# Altium schematic sheet Core.SchDoc (continued)
## Parts (continued)
C39  value 100nF  Note: ±10%  Type: 0201  [CAP_0201]  (hidden comment: C0201)
C40  value 100nF  Note: ±10%  Type: 0201  [CAP_0201]  (hidden comment: C0201)
C41  value 4.7uF  Note: ±10%  Type: 0402  [CAP_0402]  (hidden comment: C0402)
C42  value 4.7uF  Note: ±10%  Type: 0402  [CAP_0402]  (hidden comment: C0402)
C43  value 100nF  Note: ±10%  Type: 0201  [CAP_0201]  (hidden comment: C0201)
C44  value 1nF  Note: ±10%  Type: 0402  [CAP_0402]  (hidden comment: C0402)
C45  value 1nF  Note: ±10%  Type: 0402  [CAP_0402]  (hidden comment: C0402)
C46  value 100nF  Note: ±10%  Type: 0201  [CAP_0201]  (hidden comment: C0201)
C47  value 100nF  Note: ±10%  Type: 0201  [CAP_0201]  (hidden comment: C0201)
C48  value 100nF  Note: ±10%  Type: 0201  [CAP_0201]  (hidden comment: C0201)
C49  value 10uF  Note: ±10%  Type: 0603  [CAP_0603]  (hidden comment: C0603)
C50  value 10uF  Note: ±10%  Type: 0603  [CAP_0603]  (hidden comment: C0603)
C51  value 100nF  Note: ±10%  Type: 0402  [CAP_0402]  (hidden comment: C0402)
C52  value 100nF  Note: ±10%  Type: 0402  [CAP_0402]  (hidden comment: C0402)
C53  value 100nF  Note: ±10%  Type: 0402  [CAP_0402]  (hidden comment: C0402)
C54  value 100nF  Note: ±10%  Type: 0402  [CAP_0402]  (hidden comment: C0402)
C55  value 100nF  Note: ±10%  Type: 0402  [CAP_0402]  (hidden comment: C0402)
C56  value 100nF  Note: ±10%  Type: 0402  [CAP_0402]  (hidden comment: C0402)
C57  value 100nF  Note: ±10%  Type: 0201  [CAP_0201]  (hidden comment: C0201)
C58  value 22uF  Note: ±10%  Type: 0603  [CAP_0603]  (hidden comment: C0603)
C59  value 10uF  Note: ±10%  Type: 0603  [CAP_0603]  (hidden comment: C0603)
C60  value 10uF  Note: ±10%  Type: 0603  [CAP_0603]  (hidden comment: C0603)
C61  value 1uF  Note: ±10%  Type: 0402  [CAP_0402]  (hidden comment: C0402)
C62  value 100nF  Note: ±10%  Type: 0402  [CAP_0402]  (hidden comment: C0402)
C63  value 100nF  Note: ±10%  Type: 0402  [CAP_0402]  (hidden comment: C0402)
C64  value 100nF  Note: ±10%  Type: 0402  [CAP_0402]  (hidden comment: C0402)
C65  value 100nF  Note: ±10%  Type: 0402  [CAP_0402]  (hidden comment: C0402)
C66  value 100nF  Note: ±10%  Type: 0402  [CAP_0402]  (hidden comment: C0402)
C67  value 100nF  Note: ±10%  Type: 0402  [CAP_0402]  (hidden comment: C0402)
C68  value 100nF  Note: ±10%  Type: 0402  [CAP_0402]  (hidden comment: C0402)
C69  value 100nF  Note: ±10%  Type: 0402  [CAP_0402]  (hidden comment: C0402)
C70  value 100nF  Note: ±10%  Type: 0402  [CAP_0402]  (hidden comment: C0402)
C71  value 100nF  Note: ±10%  Type: 0402  [CAP_0402]  (hidden comment: C0402)
C72  value 100nF  Note: ±10%  Type: 0402  [CAP_0402]  (hidden comment: C0402)
C73  value 100nF  Note: ±10%  Type: 0402  [CAP_0402]  (hidden comment: C0402)
C74  value 100nF  Note: ±10%  Type: 0402  [CAP_0402]  (hidden comment: C0402)
C75  value 100nF  Note: ±10%  Type: 0402  [CAP_0402]  (hidden comment: C0402)
C76  value 100nF  Note: ±10%  Type: 0402  [CAP_0402]  (hidden comment: C0402)
C77  value 100nF  Note: ±10%  Type: 0402  [CAP_0402]  (hidden comment: C0402)
C78  value 22uF  Note: ±10%  Type: 0603  [CAP_0603]  (hidden comment: C0603)
C79  value 10uF  Note: ±10%  Type: 0603  [CAP_0603]  (hidden comment: C0603)
C80  value 10uF  Note: ±10%  Type: 0603  [CAP_0603]  (hidden comment: C0603)
C81  value 1uF  Note: ±10%  Type: 0402  [CAP_0402]  (hidden comment: C0402)
C82  value 100nF  Note: ±10%  Type: 0402  [CAP_0402]  (hidden comment: C0402)
C83  value 100nF  Note: ±10%  Type: 0402  [CAP_0402]  (hidden comment: C0402)
C84  value 100nF  Note: ±10%  Type: 0402  [CAP_0402]  (hidden comment: C0402)
C85  value 100nF  Note: ±10%  Type: 0402  [CAP_0402]  (hidden comment: C0402)
C86  value 100nF  Note: ±10%  Type: 0402  [CAP_0402]  (hidden comment: C0402)
C87  value 100nF  Note: ±10%  Type: 0402  [CAP_0402]  (hidden comment: C0402)
C88  value 100nF  Note: ±10%  Type: 0402  [CAP_0402]  (hidden comment: C0402)
C89  value 100nF  Note: ±10%  Type: 0402  [CAP_0402]  (hidden comment: C0402)
C90  value 100nF  Note: ±10%  Type: 0402  [CAP_0402]  (hidden comment: C0402)
C91  value 100nF  Note: ±10%  Type: 0402  [CAP_0402]  (hidden comment: C0402)
C92  value 100nF  Note: ±10%  Type: 0402  [CAP_0402]  (hidden comment: C0402)
C93  value 100nF  Note: ±10%  Type: 0402  [CAP_0402]  (hidden comment: C0402)
C94  value 100nF  Note: ±10%  Type: 0402  [CAP_0402]  (hidden comment: C0402)
C95  value 100nF  Note: ±10%  Type: 0402  [CAP_0402]  (hidden comment: C0402)
C96  value 100nF  Note: ±10%  Type: 0402  [CAP_0402]  (hidden comment: C0402)
C97  value 100nF  Note: ±10%  Type: 0402  [CAP_0402]  (hidden comment: C0402)
C98  value 100nF  Note: ±10%  Type: 0402  [CAP_0402]  (hidden comment: C0402)
C99  value 100nF  Note: ±10%  Type: 0402  [CAP_0402]  (hidden comment: C0402)
C100  value 4.7uF  Note: ±10%  Type: 0402  [CAP_0402]  (hidden comment: C0402)
C101  value 22uF  Note: ±10%  Type: 0603  [CAP_0603]  (hidden comment: C0603)
C102  value 22uF  Note: ±10%  Type: 0603  [CAP_0603]  (hidden comment: C0603)
C103  value 22uF  Note: ±10%  Type: 0603  [CAP_0603]  (hidden comment: C0603)
C104  value 100nF  Note: ±10%  Type: 0201  [CAP_0201]  (hidden comment: C0201)
C105  value 100nF  Note: ±10%  Type: 0201  [CAP_0201]  (hidden comment: C0201)
C106  value 100nF  Note: ±10%  Type: 0201  [CAP_0201]  (hidden comment: C0201)
C107  value 4.7uF  Note: ±10%  Type: 0402  [CAP_0402]  (hidden comment: C0402)
C108  value 4.7uF  Note: ±10%  Type: 0402  [CAP_0402]  (hidden comment: C0402)
C109  value 4.7uF  Note: ±10%  Type: 0402  [CAP_0402]  (hidden comment: C0402)
C110  value 10uF  Note: ±10%  Type: 0603  [CAP_0603]  (hidden comment: C0603)
C111  value 22uF  Note: ±10%  Type: 0603  [CAP_0603]  (hidden comment: C0603)
C112  value 22uF  Note: ±10%  Type: 0603  [CAP_0603]  (hidden comment: C0603)
C113  value 100nF  Note: ±10%  Type: 0201  [CAP_0201]  (hidden comment: C0201)
C114  value 4.7uF  Note: ±10%  Type: 0402  [CAP_0402]  (hidden comment: C0402)
C115  value 10uF  Note: ±10%  Type: 0603  [CAP_0603]  (hidden comment: C0603)
C116  value 22uF  Note: ±10%  Type: 0603  [CAP_0603]  (hidden comment: C0603)
C117  value 22uF  Note: ±10%  Type: 0603  [CAP_0603]  (hidden comment: C0603)
C118  value 100nF  Note: ±10%  Type: 0201  [CAP_0201]  (hidden comment: C0201)
C119  value 10uF  Note: ±10%  Type: 0603  [CAP_0603]  (hidden comment: C0603)
C120  value 22uF  Note: ±10%  Type: 0603  [CAP_0603]  (hidden comment: C0603)
C121  value 22uF  Note: ±10%  Type: 0603  [CAP_0603]  (hidden comment: C0603)
C122  value 100nF  Note: ±10%  Type: 0201  [CAP_0201]  (hidden comment: C0201)
R1  value 22Ω  Note: ±1%  Type: 0402  [RES_0402]  (hidden comment: R0402)
R2  value 1MΩ  Note: ±1%  Type: 0402  [RES_0402]  (hidden comment: R0402)
R3  value 10K  Note: ±1%  Type: 0402  [RES_0402]  (hidden comment: R0402)
R4  value 2.2K  Note: ±1%  Type: 0402  [RES_0402]  (hidden comment: R0402)
R5  value 2.2K  Note: ±1%  Type: 0402  [RES_0402]  (hidden comment: R0402)
R6  value 22Ω  Note: ±1%  Type: 0402  [RES_0402]  (hidden comment: R0402)
R7  value 1.62K  Note: ±1%  Type: 0402  [RES_0402]  (hidden comment: R0402)
R8  value 120Ω  Note: ±1%  Type: 0402  [RES_0402]  (hidden comment: R0402)
R9  value 22Ω  Note: ±1%  Type: 0402  [RES_0402]  (hidden comment: R0402)
R10  value 10K  Note: ±1%  Type: 0402  [RES_0402]  (hidden comment: R0402)
R11  value 240Ω  Note: ±1%  Type: 0402  [RES_0402]  (hidden comment: R0402)
R12  value 240Ω  Note: ±1%  Type: 0402  [RES_0402]  (hidden comment: R0402)
R13  value 22Ω  Note: ±1%  Type: 0402  [RES_0402]  (hidden comment: R0402)
R15  value 15K  Note: ±1%  Type: 0402  [RES_0402]  (hidden comment: R0402)
U1  RK3566  [RK3566]  (value not drawn)  (parts A,B,C,D,E,F,G,H,I,J,K,L,M,N,O,P,Q,R,S,T,U,V of 22)
U2  LPDDR4  [LPDDR4]  (value not drawn)  (parts A,B of 2)
X1  24MHz  [OSC-SMD_4P-L3.2-W2.5-BL]

## Nets
GND: C1.1 C2.1 C3.1 C4.1 C5.1 C6.1 C7.1 C8.1 C9.2 C10.1 C11.1 C12.1 C13.1 C14.1 C15.1 C16.1 C17.1 C18.2 C19.1 C20.1 C21.1 C22.1 C23.1 C24.2 C25.1 C26.1 C27.1 C28.1 C29.1 C30.1 C31.1 C32.1 C33.1 C34.1 C35.1 C36.1 C37.1 C38.1 C39.1 C40.1 C41.1 C42.1 C43.1 C44.1 C45.1 C46.2 C47.2 C48.2 C49.1 C50.1 C51.1 C52.1 C53.1 C54.1 C55.1 C56.1 C57.2 C58.1 C59.1 C60.1 C61.1 C62.1 C63.1 C64.1 C65.1 C66.1 C67.1 C68.1 C69.1 C70.1 C71.1 C72.1 C73.1 C74.1 C75.1 C76.1 C77.1 C78.1 C79.1 C80.1 C81.1 C82.1 C83.1 C84.1 C85.1 C86.1 C87.1 C88.1 C89.1 C90.1 C91.1 C92.1 C93.1 C94.1 C95.1 C96.1 C97.1 C98.1 C99.1 C100.1 C101.1 C102.1 C103.1 C104.1 C105.1 C106.1 C107.1 C108.1 C109.1 C110.1 C111.1 C112.1 C113.1 C114.1 C115.1 C116.1 C117.1 C118.1 C119.1 C120.1 C121.1 C122.2 R7.2 R15.1 U1.1B10(VSS_30) U1.1B11(VSS_31) U1.1B15(VSS_32) U1.1B19(VSS_33) U1.1C4(VSS_34) U1.1C5(VSS_35) U1.1C6(VSS_36) U1.1C8(VSS_37) U1.1C9(VSS_38) U1.1C14(VSS_39) U1.1C16(VSS_40) U1.1C18(VSS_41) U1.1D1(VSS_42) U1.1D3(VSS_43) U1.1D4(DDR_AVSS) U1.1D10(VSS_44) U1.1D14(VSS_45) U1.1E3(VSS_46) U1.1E8(VSS_47) U1.1E10(VSS_48) U1.1E14(VSS_49) U1.1E15(VSS_50) U1.1E17(VSS_51) U1.1F6(VSS_52) U1.1F7(VSS_53) U1.1F8(VSS_54) U1.1F9(VSS_55) U1.1F10(VSS_56) U1.1F15(VSS_57) U1.1F16(VSS_58) U1.1F20(AVSS1_6) U1.1G3(VSS_59) U1.1G6(VSS_60) U1.1G7(VSS_61) U1.1G8(VSS_62) U1.1G9(VSS_63) U1.1G10(VSS_64) U1.1G11(VSS_65) U1.1G12(VSS_66) U1.1G14(VSS_67) U1.1G16(AVSS1_7) U1.1G17(EDP_TX_AVDD_1V8) U1.1G18(AVSS1_8) U1.1G19(AVSS1_9) U1.1G20(AVSS1_10) U1.1H1(VSS_68) U1.1H2(VSS_69) U1.1H6(VSS_70) U1.1H11(VSS_71) U1.1H12(VSS_72) U1.1H13(VSS_73) U1.1H17(EDP_TX_AVDD_0V9) U1.1J1(VSS_74) U1.1J5(SYSPLL_AVSS) U1.1J6(VSS_75) U1.1J8(VSS_76) U1.1J9(VSS_77) U1.1J11(VSS_78) U1.1J12(VSS_79) U1.1J13(VSS_80) U1.1J16(AVSS1_11) U1.1J18(AVSS1_12) U1.1K2(VSS_81) U1.1K3(VSS_82) U1.1K4(VSS_83) U1.1K5(VSS_84) U1.1K6(VSS_85) U1.1K8(VSS_86) U1.1K9(VSS_87) U1.1K11(VSS_88) U1.1K12(VSS_89) U1.1K13(VSS_90) U1.1K14(VSS_91) U1.1K15(VSS_92) U1.1K18(AVSS1_13) U1.1L3(VSS_93) U1.1L6(VSS_94) U1.1L10(VSS_95) U1.1L11(VSS_96) U1.1L12(VSS_97) U1.1L13(VSS_98) U1.1L14(VSS_99) U1.1L15(VSS_100) U1.1L19(AVSS1_14) U1.1M3(VSS_101) U1.1M4(VSS_102) U1.1M5(VSS_103) U1.1M6(VSS_104) U1.1M10(VSS_105) U1.1M11(VSS_106) U1.1M12(VSS_107) U1.1M13(VSS_108) U1.1M14(VSS_109) U1.1M15(VSS_110) U1.1M16(VSS_111) U1.1M17(VSS_112) U1.1M18(TVSS) U1.1M20(VSS_113) U1.1N3(VSS_114) U1.1N4(VSS_115) U1.1N7(VSS_116) U1.1N9(MIPI_CSI_RX_AVDD_0V9) U1.1N10(MIPI_DSI_TX1_AVDD_0V9) U1.1N11(AVSS_9) U1.1N12(AVSS_10) U1.1N17(PMUPLL_AVSS) U1.1P1(VSS_117) U1.1P5(VSS_118) U1.1P6(VSS_119) U1.1P7(VSS_120) U1.1P8(AVSS_11) U1.1P9(MIPI_CSI_RX_AVDD_1V8) U1.1P10(AVSS_12) U1.1P11(MIPI_DSI_TX0/LVDS_TX0_AVDD_0V9) U1.1P12(MIPI_DSI_TX0/LVDS_TX0_AVDD_1V8) U1.1P14(AVSS_13) U1.1P15(VSS_121) U1.1R3(VSS_122) U1.1R4(VSS_123) U1.1R5(VSS_124) U1.1R6(VSS_125) U1.1R7(VSS_126) U1.1R8(AVSS_14) U1.1R9(AVSS_15) U1.1R10(MIPI_DSI_TX1_AVDD_1V8) U1.1R11(AVSS_16) U1.1R12(AVSS_17) U1.1R13(AVSS_18) U1.1R14(AVSS_19) U1.1R15(AVSS_20) U1.1T3(VSS_127) U1.1T5(VSS_128) U1.1T7(AVSS_21) U1.1T8(AVSS_22) U1.1T9(AVSS_23) U1.1T10(AVSS_24) U1.1T11(AVSS_25) U1.1T12(AVSS_26) U1.1T13(AVSS_27) U1.1T14(AVSS_28) U1.1T15(AVSS_29) U1.1T16(AVSS_30) U1.1T17(AVSS_31) U1.1U2(VSS_129) U1.1U12(AVSS_32) U1.1U13(AVSS_33) U1.1U15(AVSS_34) U1.1U17(AVSS_35) U1.1V1(VSS_130) U1.1V4(VSS_131) U1.1V7(AVSS_36) U1.1V12(AVSS_37) U1.1V13(AVSS_38) U1.1V18(AVSS_39) U1.A1(VSS_1) U1.A2(VSS_2) U1.A38(VSS_3) U1.AA2(VSS_18) U1.AC37(VSS_24) U1.AD2(VSS_19) U1.AE37(VSS_25) U1.AH37(VSS_26) U1.AL37(VSS_27) U1.AP2(VSS_20) U1.AP8(VSS_22) U1.AP13(AVSS_1) U1.AP16(AVSS_2) U1.AP19(AVSS_3) U1.AP22(AVSS_4) U1.AP25(AVSS_5) U1.AP28(AVSS_6) U1.AP31(AVSS_7) U1.AP34(AVSS_8) U1.AP37(VSS_28) U1.AR1(VSS_21) U1.AR38(VSS_29) U1.B1(VSS_4) U1.B2(VSS_5) U1.B6(VSS_6) U1.B11(VSS_7) U1.B14(VSS_8) U1.B18(VSS_9) U1.B21(VSS_10) U1.B28(VSS_11) U1.B31(VSS_12) U1.D2(VSS_13) U1.E37(VSS_23) U1.H37(AVSS1_1) U1.J2(VSS_14) U1.L2(VSS_15) U1.L37(AVSS1_2) U1.P37(AVSS1_3) U1.U2(VSS_16) U1.U37(AVSS1_4) U1.W2(VSS_17) U1.Y37(AVSS1_5) U2.A3(VSS_1) U2.A10(VSS_2) U2.AB3(VSS_55) U2.AB5(VSS_56) U2.AB8(VSS_57) U2.AB10(VSS_58) U2.C1(VSS_3) U2.C5(VSS_4) U2.C8(VSS_5) U2.C12(VSS_6) U2.D2(VSS_7) U2.D4(VSS_8) U2.D9(VSS_9) U2.D11(VSS_10) U2.E1(VSS_11) U2.E5(VSS_12) U2.E8(VSS_13) U2.E12(VSS_14) U2.G1(VSS_15) U2.G3(VSS_16) U2.G5(VSS_17) U2.G8(VSS_18) U2.G10(VSS_19) U2.G12(VSS_20) U2.J1(VSS_21) U2.J3(VSS_22) U2.J10(VSS_23) U2.J12(VSS_24) U2.K2(VSS_25) U2.K4(VSS_26) U2.K9(VSS_27) U2.K11(VSS_28) U2.N2(VSS_29) U2.N4(VSS_30) U2.N9(VSS_31) U2.N11(VSS_32) U2.P1(VSS_33) U2.P3(VSS_34) U2.P10(VSS_35) U2.P12(VSS_36) U2.T1(VSS_37) U2.T3(VSS_38) U2.T5(VSS_39) U2.T8(VSS_40) U2.T10(VSS_41) U2.T12(VSS_42) U2.V1(VSS_43) U2.V5(VSS_44) U2.V8(VSS_45) U2.V12(VSS_46) U2.W2(VSS_47) U2.W4(VSS_48) U2.W9(VSS_49) U2.W11(VSS_50) U2.Y1(VSS_51) U2.Y5(VSS_52) U2.Y8(VSS_53) U2.Y12(VSS_54) X1.2(GND) X1.4(GND)
VCC0V6_DDR: C33.2 C34.2 C35.2 C36.2 C38.2 C39.2 C40.2 C41.2 C42.2 C58.2 C59.2 C60.2 C61.2 C62.2 C63.2 C64.2 C65.2 C66.2 C67.2 C68.2 C69.2 C70.2 C71.2 C72.2 C73.2 C74.2 C75.2 C76.2 C77.2 C78.2 C79.2 C80.2 C81.2 C82.2 C83.2 C84.2 C85.2 C86.2 C87.2 C88.2 C89.2 C90.2 C91.2 C92.2 C93.2 C94.2 C95.2 C96.2 C97.2 C98.2 C99.2 R8.2 R11.1 R12.2 U1.1D5(DDR_VDDQ_1) U1.1D6(DDR_VDDQ_2) U1.1D7(DDR_VDDQ_3) U1.1D8(DDR_VDDQ_4) U1.1D9(DDR_VDDQ_5) U1.1E4(DDR_VDDQ_6) U1.1E6(DDR_VDDQL_1) U1.1E7(DDR_VDDQL_2) U1.1E9(DDR_VDDQL_3) U1.1F4(DDR_VDDQ_7) U1.1F5(DDR_VDDQL_4) U1.1G4(DDR_VDDQ_8) U1.1G5(DDR_VDDQL_5) U2.A4(VDD2_1) U2.A9(VDD2_2) U2.AA3(VDDQ_17) U2.AA5(VDDQ_18) U2.AA8(VDDQ_19) U2.AA10(VDDQ_20) U2.AB4(VDD2_23) U2.AB9(VDD2_24) U2.B3(VDDQ_1) U2.B5(VDDQ_2) U2.B8(VDDQ_3) U2.B10(VDDQ_4) U2.D1(VDDQ_5) U2.D5(VDDQ_6) U2.D8(VDDQ_7) U2.D12(VDDQ_8) U2.F3(VDDQ_9) U2.F5(VDD2_3) U2.F8(VDD2_4) U2.F10(VDDQ_10) U2.H1(VDD2_5) U2.H5(VDD2_6) U2.H8(VDD2_7) U2.H12(VDD2_8) U2.K1(VDD2_9) U2.K3(VDD2_10) U2.K10(VDD2_11) U2.K12(VDD2_12) U2.N1(VDD2_13) U2.N3(VDD2_14) U2.N10(VDD2_15) U2.N12(VDD2_16) U2.R1(VDD2_17) U2.R5(VDD2_18) U2.R8(VDD2_19) U2.R12(VDD2_20) U2.U3(VDDQ_11) U2.U5(VDD2_21) U2.U8(VDD2_22) U2.U10(VDDQ_12) U2.W1(VDDQ_13) U2.W5(VDDQ_14) U2.W8(VDDQ_15) U2.W12(VDDQ_16)  [also labelled VCC_DDR]
VCC1V8_DDR: C14.2 C15.2 C49.2 C50.2 C51.2 C52.2 C53.2 C54.2 C55.2 C56.2 U1.1N18(PMUPLL_AVDD_1V9) U2.F1(VDD1) U2.F12(VDD1_2) U2.G4(VDD1_3) U2.G9(VDD1_4) U2.T4(VDD1_5) U2.T9(VDD1_6) U2.U1(VDD1_7) U2.U12(VDD1_8)  [also labelled VCCA1V8_PMU]
VCC3V3_PMU: C9.1 C18.1 R3.2 R4.1 R5.1 U1.1N15(PMUIO2) U1.1P16(PMUIO1)
VCC_1V8: C27.2 C30.2 C57.1 U1.1C13(VCCIO2) U1.1E16(VCCIO4)  [also labelled VCCIO_FLASH, VCCIO_WL]
VCC_3V3: C6.2 C13.2 C47.1 C48.1 U1.1H18(USB_AVDD1_3V3) U1.1J2(USB_AVDD2_3V3) U1.1N5(VCCIO5_1) U1.1N6(VCCIO5_2) U1.1N8(VCCIO7)
VCCA1V8_IMAGE: C31.2 C32.2 U1.1P13(HDMI_TX_AVDD_1V8)
VCCA_1V8: C7.2 C10.2 C19.2 C22.2 C23.2 C46.1 R10.2 U1.1D15(OTP_VCC18) U1.1D16(SARADC_AVDD_1V8) U1.1H4(SYSPLL_AVDD_1V8) U1.1H16(USB_AVDD1_1V9) U1.1J3(USB_AVDD2_1V8) U1.1K17(MULTI_PHY_AVDD_1V8)
VCCIO_ACODEC: C122.1 U1.1D13(VCCIO1)
VCCIO_SD: C43.2 U1.1F17(VCCIO3)
VDD_CPU: C37.2 C100.2 C101.2 C102.2 C103.2 C104.2 C105.2 U1.1C12(VDD_CPU_1) U1.1D11(VDD_CPU_2) U1.1D12(VDD_CPU_3) U1.1E11(VDD_CPU_4) U1.1E12(VDD_CPU_5) U1.1E13(VDD_CPU_6) U1.1F11(VDD_CPU_7) U1.1F12(VDD_CPU_8) U1.1F13(VDD_CPU_9) U1.1F14(VDD_CPU_10) U1.1G13(VDD_CPU_11)
VDD_GPU: C113.2 C114.2 C115.2 C116.2 C117.2 U1.1L8(VDD_GPU_1) U1.1L9(VDD_GPU_2) U1.1M7(VDD_GPU_3) U1.1M8(VDD_GPU_4) U1.1M9(VDD_GPU_5)
VDD_LOGIC: C106.2 C107.2 C108.2 C109.2 C110.2 C111.2 C112.2 U1.1H7(VDD_LOGIC_1) U1.1H8(VDD_LOGIC_2) U1.1H9(VDD_LOGIC_3) U1.1H10(VDD_LOGIC_4) U1.1J7(VDD_LOGIC_5) U1.1J10(VDD_LOGIC_6) U1.1K7(VDD_LOGIC_7) U1.1K10(VDD_LOGIC_8) U1.1L7(VDD_LOGIC_9)
VDD_NPU: C118.2 C119.2 C120.2 C121.2 U1.1G15(VDD_NPU_1) U1.1H14(VDD_NPU_2) U1.1H15(VDD_NPU_3) U1.1J14(VDD_NPU_4) U1.1J15(VDD_NPU_5)
VDDA0V9_IMAGE: C28.2 C29.2 U1.1N13(HDMI_TX_AVDD_02V9_2) U1.1N14(HDMI_TX_AVDD_02V9_1)
VDDA0V9_PMU: C11.2 C12.2 C24.1 C25.2 U1.1N16(PMU_VDD_LOGIC_0V9) U1.1P17(PMUPLL_AVDD_0V9)
VDDA_0V9: C5.2 C8.2 C16.2 C17.2 C20.2 C21.2 U1.1H5(SYSPLL_AVDD_0V9) U1.1J4(USB_AVDD2_0V9) U1.1J17(USB_AVDD1_0V9) U1.1K16(MULTI_PHY_AVDD_0V9)
BT_REG_ON_H: U1.D38(GPIO2_B7_d)
BT_WAKE_HOST_H: U1.A37(GPIO2_C0_d)
EMMC_CLKOUT: R6.2
EMMC_CMD: U1.A27(GPIO1_C4_u)
EMMC_D0: U1.A32(GPIO1_B4_u)
EMMC_D1: U1.B27(GPIO1_B5_u)
EMMC_D2: U1.B32(GPIO1_B6_u)
EMMC_D3: U1.B29(GPIO1_B7_u)
EMMC_D4: U1.B33(GPIO1_C0_u)
EMMC_D5: U1.A30(GPIO1_C1_u)
EMMC_D6: U1.B30(GPIO1_C2_u)
EMMC_D7: U1.A33(GPIO1_C3_u)
EMMC_DATA_STROBE: U1.1A16(GPIO1_C6_d)
EMMC_RSTN: U1.1B16(GPIO1_C7_d)
FLASH_VOL_SEL: R3.1 U1.AF38(GPIO0_A7_u)
HDMI_TX_CLK_N: U1.AP32(HDMI_TX_CLKn)
HDMI_TX_CLK_P: U1.AR32(HDMI_TX_CLKp)
HDMI_TX_D0_N: U1.AR33(HDMI_TX_D0n)
HDMI_TX_D0_P: U1.AP33(HDMI_TX_D0p)
HDMI_TX_D1_N: U1.AP35(HDMI_TX_D1n)
HDMI_TX_D1_P: U1.AR35(HDMI_TX_D1p)
HDMI_TX_D2_N: U1.AR36(HDMI_TX_D2n)
HDMI_TX_D2_P: U1.AP36(HDMI_TX_D2p)
HDMI_TX_HPDIN: C26.2 U1.1V17(HDMI_TX_HPDIN)
HDMITX_CEC_M0: U1.1V5(GPIO4_D1_u)
HDMITX_SCL: U1.AR12(GPIO4_C7_u)
HDMITX_SDA: U1.AP11(GPIO4_D0_u)
HOST_WAKE_BT_H: U1.B36(GPIO2_C1_d)
HW_ID: C45.2 R10.1 U1.1C17(SARADC_VIN1)
I2C0_SCL_PMIC: R4.2 U1.AJ37(GPIO0_B1_u)
I2C0_SDA_PMIC: R5.2 U1.AK38(GPIO0_B2_u)
I2S1_LRCK_TX_M0_PMIC: U1.B24(GPIO1_A5_d)
I2S1_MCLK_M0_PMIC: U1.A23(GPIO1_A2_d)
I2S1_SCLK_TX_M0_PMIC: U1.B23(GPIO1_A3_d)
I2S1_SDI0_M0/PDM: U1.1B14(GPIO1_B3_d)
I2S1_SDO0_M0_PMIC: U1.B25(GPIO1_A7_d)
I2S2_LRCK_TX_M0: U1.1D19(GPIO2_C3_d)
I2S2_SCLK_TX_M0: U1.C37(GPIO2_C2_d)
I2S2_SDI_M0: U1.D37(GPIO2_C5_d)
I2S2_SDO_M0: U1.1B20(GPIO2_C4_d)
LPDDR4_A0_A: U1.C2(LPDDR4_A0_A) U2.H2(CA0_A)
LPDDR4_A0_B: U1.A9(LPDDR4_A0_B) U2.R2(CA0_B)
LPDDR4_A1_A: U1.C1(LPDDR4_A1_A) U2.J2(CA1_A)
LPDDR4_A1_B: U1.B9(LPDDR4_A1_B) U2.P2(CA1_B)
LPDDR4_A2_A: U1.1C1(LPDDR4_A2_A) U2.H9(CA2_A)
LPDDR4_A2_B: U1.1B7(LPDDR4_A2_B) U2.R9(CA2_B)
LPDDR4_A3_A: U1.1B3(LPDDR4_A3_A) U2.H10(CA3_A)
LPDDR4_A3_B: U1.1B6(LPDDR4_A3_B) U2.R10(CA3_B)
LPDDR4_A4_A: U1.1B1(LPDDR4_A4_A) U2.H11(CA4_A)
LPDDR4_A4_B: U1.1A6(LPDDR4_A4_B) U2.R11(CA4_B)
LPDDR4_A5_A: U1.1A1(LPDDR4_A5_A) U2.J11(CA5_A)
LPDDR4_A5_B: U1.B8(LPDDR4_A5_B) U2.P11(CA5_B)
LPDDR4_CKE0_A: U1.B4(LPDDR4_CKE0_A) U2.J4(CKE0_A)
LPDDR4_CKE0_B: U1.1A3(LPDDR4_CKE0_B) U2.P4(CKE0_B)
LPDDR4_CKE1_A: U1.1C3(LPDDR4_CKE1_A) U2.J5(CKE1_A)
LPDDR4_CKE1_B: U1.1A2(LPDDR4_CKE1_B) U2.P5(CKE1_B)
LPDDR4_CLK_A_N: U1.B5(LPDDR4_CLKN_A) U2.J9(CK_c_A)
LPDDR4_CLK_A_P: U1.A5(LPDDR4_CLKP_A) U2.J8(CK_t_A)
LPDDR4_CLK_B_N: U1.B7(LPDDR4_CLKN_B) U2.P9(CK_c_B)
LPDDR4_CLK_B_P: U1.A7(LPDDR4_CLKP_B) U2.P8(CK_t_B)
LPDDR4_CS0N_A: U1.B3(LPDDR4_CS0n_A) U2.H4(CS0_A)
LPDDR4_CS0N_B: U1.1B5(LPDDR4_CS0n_B) U2.R4(CS0_B)
LPDDR4_CS1N_A: U1.A3(LPDDR4_CS1n_A) U2.H3(CS1_A)
LPDDR4_CS1N_B: U1.1A5(LPDDR4_CS1n_B) U2.R3(CS1_B)
LPDDR4_DM0_A: U1.1E2(LPDDR4_DM0_A) U2.C3(DMI0_A)
LPDDR4_DM0_B: U1.1B8(LPDDR4_DM0_B) U2.Y3(DMI0_B)
LPDDR4_DM1_A: U1.1G1(LPDDR4_DM1_A) U2.C10(DMI1_A)
LPDDR4_DM1_B: U1.1A11(LPDDR4_DM1_B) U2.Y10(DMI1_B)
LPDDR4_DQ0_A: U1.G2(LPDDR4_DQ0_A) U2.B2(DQ0_A)
LPDDR4_DQ0_B: U1.B12(LPDDR4_DQ0_B) U2.AA2(DQ0_B)
LPDDR4_DQ1_A: U1.F2(LPDDR4_DQ1_A) U2.C2(DQ1_A)
LPDDR4_DQ1_B: U1.B10(LPDDR4_DQ1_B) U2.Y2(DQ1_B)
LPDDR4_DQ2_A: U1.F1(LPDDR4_DQ2_A) U2.E2(DQ2_A)
LPDDR4_DQ2_B: U1.1A8(LPDDR4_DQ2_B) U2.V2(DQ2_B)
LPDDR4_DQ3_A: U1.E1(LPDDR4_DQ3_A) U2.F2(DQ3_A)
LPDDR4_DQ3_B: U1.1A7(LPDDR4_DQ3_B) U2.U2(DQ3_B)
LPDDR4_DQ4_A: U1.M2(LPDDR4_DQ4_A) U2.F4(DQ4_A)
LPDDR4_DQ4_B: U1.B13(LPDDR4_DQ4_B) U2.U4(DQ4_B)
LPDDR4_DQ5_A: U1.K1(LPDDR4_DQ5_A) U2.E4(DQ5_A)
LPDDR4_DQ5_B: U1.1A10(LPDDR4_DQ5_B) U2.V4(DQ5_B)
LPDDR4_DQ6_A: U1.K2(LPDDR4_DQ6_A) U2.C4(DQ6_A)
LPDDR4_DQ6_B: U1.1B9(LPDDR4_DQ6_B) U2.Y4(DQ6_B)
LPDDR4_DQ7_A: U1.1E1(LPDDR4_DQ7_A) U2.B4(DQ7_A)
LPDDR4_DQ7_B: U1.1A9(LPDDR4_DQ7_B) U2.AA4(DQ7_B)
LPDDR4_DQ8_A: U1.P2(LPDDR4_DQ8_A) U2.B11(DQ8_A)
LPDDR4_DQ8_B: U1.B19(LPDDR4_DQ8_B) U2.AA11(DQ8_B)
LPDDR4_DQ9_A: U1.R1(LPDDR4_DQ9_A) U2.C11(DQ9_A)
LPDDR4_DQ9_B: U1.A19(LPDDR4_DQ9_B) U2.Y11(DQ9_B)
LPDDR4_DQ10_A: U1.R2(LPDDR4_DQ10_A) U2.E11(DQ10_A)
LPDDR4_DQ10_B: U1.A20(LPDDR4_DQ10_B) U2.V11(DQ10_B)
LPDDR4_DQ11_A: U1.T2(LPDDR4_DQ11_A) U2.F11(DQ11_A)
LPDDR4_DQ11_B: U1.B20(LPDDR4_DQ11_B) U2.U11(DQ11_B)
LPDDR4_DQ12_A: U1.M1(LPDDR4_DQ12_A) U2.F9(DQ12_A)
LPDDR4_DQ12_B: U1.A15(LPDDR4_DQ12_B) U2.U9(DQ12_B)
LPDDR4_DQ13_A: U1.1F2(LPDDR4_DQ13_A) U2.E9(DQ13_A)
LPDDR4_DQ13_B: U1.B15(LPDDR4_DQ13_B) U2.V9(DQ13_B)
LPDDR4_DQ14_A: U1.1F1(LPDDR4_DQ14_A) U2.C9(DQ14_A)
LPDDR4_DQ14_B: U1.1C10(LPDDR4_DQ14_B) U2.Y9(DQ14_B)
LPDDR4_DQ15_A: U1.1G2(LPDDR4_DQ15_A) U2.B9(DQ15_A)
LPDDR4_DQ15_B: U1.B16(LPDDR4_DQ15_B) U2.AA9(DQ15_B)
LPDDR4_DQS0_A_N: U1.H1(LPDDR4_DQS0N_A) U2.E3(DQS0_c_A)
LPDDR4_DQS0_A_P: U1.H2(LPDDR4_DQS0P_A) U2.D3(DQS0_t_A)
LPDDR4_DQS0_B_N: U1.A12(LPDDR4_DQS0N_B) U2.V3(DQS0_c_B)
LPDDR4_DQS0_B_P: U1.A13(LPDDR4_DQS0P_B) U2.W3(DQS0_t_B)
LPDDR4_DQS1_A_N: U1.N2(LPDDR4_DQS1N_A) U2.E10(DQS1_c_A)
LPDDR4_DQS1_A_P: U1.N1(LPDDR4_DQS1P_A) U2.D10(DQS1_t_A)
LPDDR4_DQS1_B_N: U1.B17(LPDDR4_DQS1N_B) U2.V10(DQS1_c_B)
LPDDR4_DQS1_B_P: U1.A17(LPDDR4_DQS1P_B) U2.W10(DQS1_t_B)
LPDDR4_ODT0_CA_A: U1.E2(LPDDR4_ODT0_CA_A) U2.G2(ODT_CA_A)
LPDDR4_ODT0_CA_B: U1.A10(LPDDR4_ODT0_CA_B) U2.T2(ODT_CA_B)
LPDDR4_RESETN: U1.1C7(LPDDR4_RESETn) U2.T11(RESET_n)
PDM_CLK0_M0_PMIC: U1.1A14(GPIO1_A6_d)
PMIC_INT_L: U1.1R19(GPIO0_A3_u)
PMIC_SLEEP_H: U1.1P19(GPIO0_A2_d)
RESETN: C2.2 U1.1R20(GPIO0_A1_z) U1.AG38(nPOR_u)  [also labelled TSADC_SEUT_M0]
RGB_LED_B: U1.1B13(GPIO1_B0_d)
RGB_LED_G: U1.A26(GPIO1_B1_d)
RGB_LED_R: U1.B26(GPIO1_B2_d)
SARADC_VIN0: C44.2 U1.1D17(SARADC_VIN0)
SDMMC0_CLK: R9.2
SDMMC0_CMD: U1.1E19(GPIO2_A1_u)
SDMMC0_D0: U1.1E20(GPIO1_D5_u)
SDMMC0_D1: U1.1F19(GPIO1_D6_u)
SDMMC0_D2: U1.1D20(GPIO1_D7_u)
SDMMC0_D3: U1.1F18(GPIO2_A0_u)
SDMMC0_DET_L: U1.AF37(GPIO0_A4_u)
SDMMC1_CLK: R13.2
SDMMC1_CMD: U1.B35(GPIO2_A7_u)
SDMMC1_D0: U1.1C19(GPIO2_A3_u)
SDMMC1_D1: U1.1E18(GPIO2_A4_u)
SDMMC1_D2: U1.1D18(GPIO2_A5_u)
SDMMC1_D3: U1.1A20(GPIO2_A6_u)
SPI3_CLK_M1: U1.1U7(GPIO4_C2_d)
SPI3_MOSI_M1: U1.AP12(GPIO4_C3_d)
TFT_BLK: U1.AP3(GPIO3_C2_d)
TFT_DC: U1.AR7(GPIO3_B0_d)
TFT_REC: U1.1V2(GPIO3_B6_d)
UART1_CTSN_M0: U1.G37(GPIO2_B6_u)
UART1_RTSN_M0: U1.F37(GPIO2_B5_u)
UART1_RX_M0: U1.1C20(GPIO2_B3_u)
UART1_TX_M0: U1.F38(GPIO2_B4_u)
UART2_RX_M0_DEBUG: U1.1V19(GPIO0_D0_u)
UART2_TX_M0_DEBUG: U1.1U18(GPIO0_D1_u)
USB_HOST2_N: U1.V1(USB_HOST2_DM)
USB_HOST2_P: U1.V2(USB_HOST2_DP)
USB_HOST3_N: U1.Y1(USB_HOST3_DM)
USB_HOST3_P: U1.Y2(USB_HOST3_DP)
USB_OTG0_N: U1.R38(USB_OTG0_DM)
USB_OTG0_P: U1.R37(USB_OTG0_DP)
USB_OTG0_VBUSDET: C1.2 R15.2 U1.T38(USB_OTG0_VBUSDET)
WIFI_REG_ON_H: U1.A35(GPIO2_B1_d)
WIFI_WAKE_HOST_H: U1.B34(GPIO2_B2_u)
NetC3_2: C3.2 R2.1 U1.AD37(XIN24M) X1.3
NetC4_2: C4.2 R1.1 X1.1
NetR1_2: R1.2 R2.2 U1.AD38(XOUT24M)
NetR6_1: R6.1 U1.A29(GPIO1_C5_d)
NetR7_1: R7.1 U1.1U16(HDMI_TX_REXT)
NetR8_1: R8.1 U1.1F3(DDR_RZQ)
NetR9_1: R9.1 U1.G38(GPIO2_A2_d)
NetR11_2: R11.2 U2.A5(ZQ0_A)
NetR12_1: R12.1 U2.A8(ZQ1_A)
NetR13_1: R13.1 U1.B37(GPIO2_B0_d)

Not connected (* = marked no-connect by the designer): U1 1A4(LPDDR4_ODT1_CA_B)* 1A13(GPIO1_A4_d)* 1A15(GPIO1_D0_d)* 1A17(GPIO1_D1_u)* 1A18(GPIO1_D2_u)* 1A19(SARADC_VIN3)* 1B17(GPIO1_D3_u)* 1B18(SARADC_VIN2)* 1C2(LPDDR4_ODT1_CA_A)* 1C15(GPIO1_D4_u)* 1D2* 1H3(ODR_VREFOUT)* 1H19(EDP_TX_AUXp)* 1H20(EDP_TX_AUXn)* 1J19(USB_HOST1_DP)* 1J20(USB_HOST1_DM)* 1K19(PCIE20_REFCLKp)* 1K20(PCIE20_REFCLKn)* 1L1(GPIO4_B6_d)* 1L2(GPIO4_B0_d)* 1L4(VCCIO6_1)* 1L5(VCCIO6_2)* 1M19(GPIO0_D4_d)* 1N1(GPIO4_A7_d)* 1N2(GPIO4_A4_d)* 1N19(GPIO0_D3_d)* 1N20(GPIO0_D5_d)* 1P2(GPIO4_A1_d)* 1P3(GPIO3_C4_d)* 1P4(GPIO3_C5_d)* 1P18(GPIO0_A0_d)* 1P20(GPIO0_D6_d)* 1R1(GPIO4_A2_d)* 1R2(GPIO3_D4_d)* 1R16(GPIO0_B6_u)* 1R17(GPIO0_B7_d)* 1R18(GPIO0_C1_d)* 1T1(GPIO3_D5_d)* 1T2(GPIO3_C6_d)* 1T4(GPIO3_B5_d)* 1T6(GPIO4_C6_d)* 1T18(GPIO0_C6_d)* 1T19(GPIO0_C0_d)* 1T20(GPIO0_B0_u)* 1U1(GPIO3_C7_d)* 1U3(GPIO3_B4_d)* 1U4(GPIO3_A6_d)* 1U5(GPIO3_A1_d)* 1U6(GPIO4_C5_d)* 1U8(MIPI_CSI_RX_CLK1n)* 1U9(MIPI_CSI_RX_CLK0n)* 1U11(MIPI_DSI_TX1_CLKn)* 1U19(GPIO0_C5_d)* 1U20(GPIO0_B5_u)* 1V3(GPIO3_A7_d)* 1V6(GPIO4_C4_d)* 1V8(MIPI_CSI_RX_CLK1p)* 1V9(MIPI_CSI_RX_CLK0p)* 1V11(MIPI_DSI_TX1_CLKp)* 1V15(MIPI_DSI_TX0_CLKn/LVDS_TX0_CLKn)* 1V16(MIPI_DSI_TX0_CLKp/LVDS_TX0_CLKp)* 1V20(GPIO0_C7_d)* A22(GPIO1_A0_u)* AA37(PCIE20_TXp/SATA2_TXp)* AA38(PCIE20_TXn/SATA2_TXn)* AB1(GPIO4_C1_d)* AB2(GPIO4_C0_d)* AB37(PCIE20_RXp/SATA2_RXp)* AB38(PCIE20_RXn/SATA2_RXn)* AC2(GPIO4_B7_d)* AD1(GPIO4_B5_d)* AE2(GPIO4_B3_d)* AF1(GPIO4_B4_d)* AF2(GPIO4_B2_d)* AG2(GPIO4_B1_d)* AG37(GPIO0_A5_d)* AH2(GPIO4_A6_d)* AJ1(GPIO4_A5_d)* AJ2(GPIO4_A3_d)* AJ38(GPIO0_A6_d)* AK2(GPIO4_A0_d)* AK37(GPIO0_B3_u)* AL1(GPIO3_D7_d)* AL2(GPIO3_D6_d)* AM1(GPIO3_D3_d)* AM2(GPIO3_D2_d)* AM37(GPIO0_C2_d)* AM38(GPIO0_B4_u)* AN2(GPIO3_D1_d)* AN37(GPIO0_C4_d)* AN38(GPIO0_C3_d)* AP1(GPIO3_D0_d)* AP4(GPIO3_C1_d)* AP5(GPIO3_B7_d)* AP6(GPIO3_B3_d)* AP7(GPIO3_B1_d)* AP9(GPIO3_A5_d)* AP10(GPIO3_A3_d)* AP14(MIPI_CSI_RX_D3n)* AP15(MIPI_CSI_RX_D2p)* AP17(MIPI_CSI_RX_D1n)* AP18(MIPI_CSI_RX_D0p)* AP20(MIPI_DSI_TX1_D3n)* AP21(MIPI_DSI_TX1_D2p)* AP23(MIPI_DSI_TX1_D1n)* AP24(MIPI_DSI_TX1_D0p)* AP26(MIPI_DSI_TX0_D0p/LVDS_TX0_D3n)* AP27(MIPI_DSI_TX0_D0p/LVDS_TX0_D2p)* AP29(MIPI_DSI_TX0_D0p/LVDS_TX0_D1n)* AP30(MIPI_DSI_TX0_D0p/LVDS_TX0_D0p)* AR2(GPIO3_C3_d)* AR4(GPIO3_C0_d)* AR6(GPIO3_B2_d)* AR9(GPIO3_A4_d)* AR10(GPIO3_A2_d)* AR14(MIPI_CSI_RX_D3p)* AR15(MIPI_CSI_RX_D2n)* AR17(MIPI_CSI_RX_D1p)* AR18(MIPI_CSI_RX_D0n)* AR20(MIPI_DSI_TX1_D3p)* AR21(MIPI_DSI_TX1_D2n)* AR23(MIPI_DSI_TX1_D1p)* AR24(MIPI_DSI_TX1_D0n)* AR26(MIPI_DSI_TX0_D0p/LVDS_TX0_D3p)* AR27(MIPI_DSI_TX0_D0p/LVDS_TX0_D2n)* AR29(MIPI_DSI_TX0_D0p/LVDS_TX0_D1p)* AR30(MIPI_DSI_TX0_D0p/LVDS_TX0_D0n)* B22(GPIO1_A1_u)* B38(GPIO2_C6_d)* J37(EDP_TX_D0p)* J38(EDP_TX_D0n)* K37(EDP_TX_D1n)* K38(EDP_TX_D1p)* M37(EDP_TX_D2p)* M38(EDP_TX_D2n)* N37(EDP_TX_D3p)* N38(EDP_TX_D3n)* T37(USB_OTG0_ID)* V37(USB3_HOST1_SSRXn/SATA1_RXx)* V38(USB3_HOST1_SSRXp/SATA1_RXp)* W37(USB3_HOST1_SSTXp/SATA1_TXp)* W38(USB3_HOST1_SSTXn/SATA1_TXn)*; U2 A1(DNU_1)* A2(DNU_2)* A11(DNU_3)* A12(DNU_4)* AA1(DNU_7)* AA12(DNU_8)* AB1(DNU_9)* AB2(DNU_10)* AB11(DNU_11)* AB12(DNU_12)* B1(DNU_5)* B12(DNU_6)* G11(ZQ2_A_NC)* K5(CS2_A_NC)* K8(CKE2_A_NC)* N5(CS2_B_NC)* N8(CKE2_B_NC)*

## Layout directives
differential pair; net class 100ohm: HDMI_TX_CLK_N, HDMI_TX_CLK_P, HDMI_TX_D0_N, HDMI_TX_D0_P, HDMI_TX_D1_N, HDMI_TX_D1_P, HDMI_TX_D2_N, HDMI_TX_D2_P, LPDDR4_CLK_A_N, LPDDR4_CLK_A_P, LPDDR4_CLK_B_N, LPDDR4_CLK_B_P, LPDDR4_DQS0_A_N, LPDDR4_DQS0_A_P, LPDDR4_DQS0_B_N, LPDDR4_DQS0_B_P, LPDDR4_DQS1_A_N, LPDDR4_DQS1_A_P, LPDDR4_DQS1_B_N, LPDDR4_DQS1_B_P
differential pair; net class 90ohm: USB_HOST2_N, USB_HOST2_P, USB_HOST3_N, USB_HOST3_P, USB_OTG0_N, USB_OTG0_P
differential pair: HDMI_TX_CLK_N

## Notes on the sheet
- Power
- USB
- OSC/PLL/PMUIO1/2
- NOT USED
- 底板增加一个10kΩ上拉电阻到USB5V
- LPDDR4
- EMMC
- HDMI
- SD CARD
- VCCIO
- 嘉立创此处的10uF电容放在电源模块处
- 造“派”计划 RK3566核心板 V1.3
- WIFI_BT

## Library data of the parts
C1-C4 C11 C14 C21 C22 C25 C27 C29 C36 C37 C41 C42 C44 C45 C51-C56 C61-C77 C81-C100 C107-C109 C114 = Cap_0402: Capacitor; Specification: X7R, ±10%, 16V; Manufacturer: *
C5-C10 C12 C13 C15-C20 C23 C24 C26 C28 C30-C35 C38-C40 C43 C46-C48 C57 C104-C106 C113 C118 C122 = Cap_0201: Capacitor; Specification: X7R, ±10%, 16V; Manufacturer: *
C49 C50 C58-C60 C78-C80 C101-C103 C110-C112 C115-C117 C119-C121 = Cap_0603: Capacitor; Specification: X7R, ±10%, 16V; Manufacturer: *
R1-R13 R15 = Res_0402: Resistor; Manufacturer: *; Specification: ±1%
U1 = RK3566: Add into BOM: yes; Symbol: RK3566; Device: RK3566; Convert to PCB: yes
U2 = LPDDR4: Add into BOM: yes; Symbol: LPDDR4; Device: LPDDR4; Convert to PCB: yes
X1 = XL2EL89COI-111YLC-24M